# EasyEDA Pro project 嵌入式.eprj, board 运控-电机
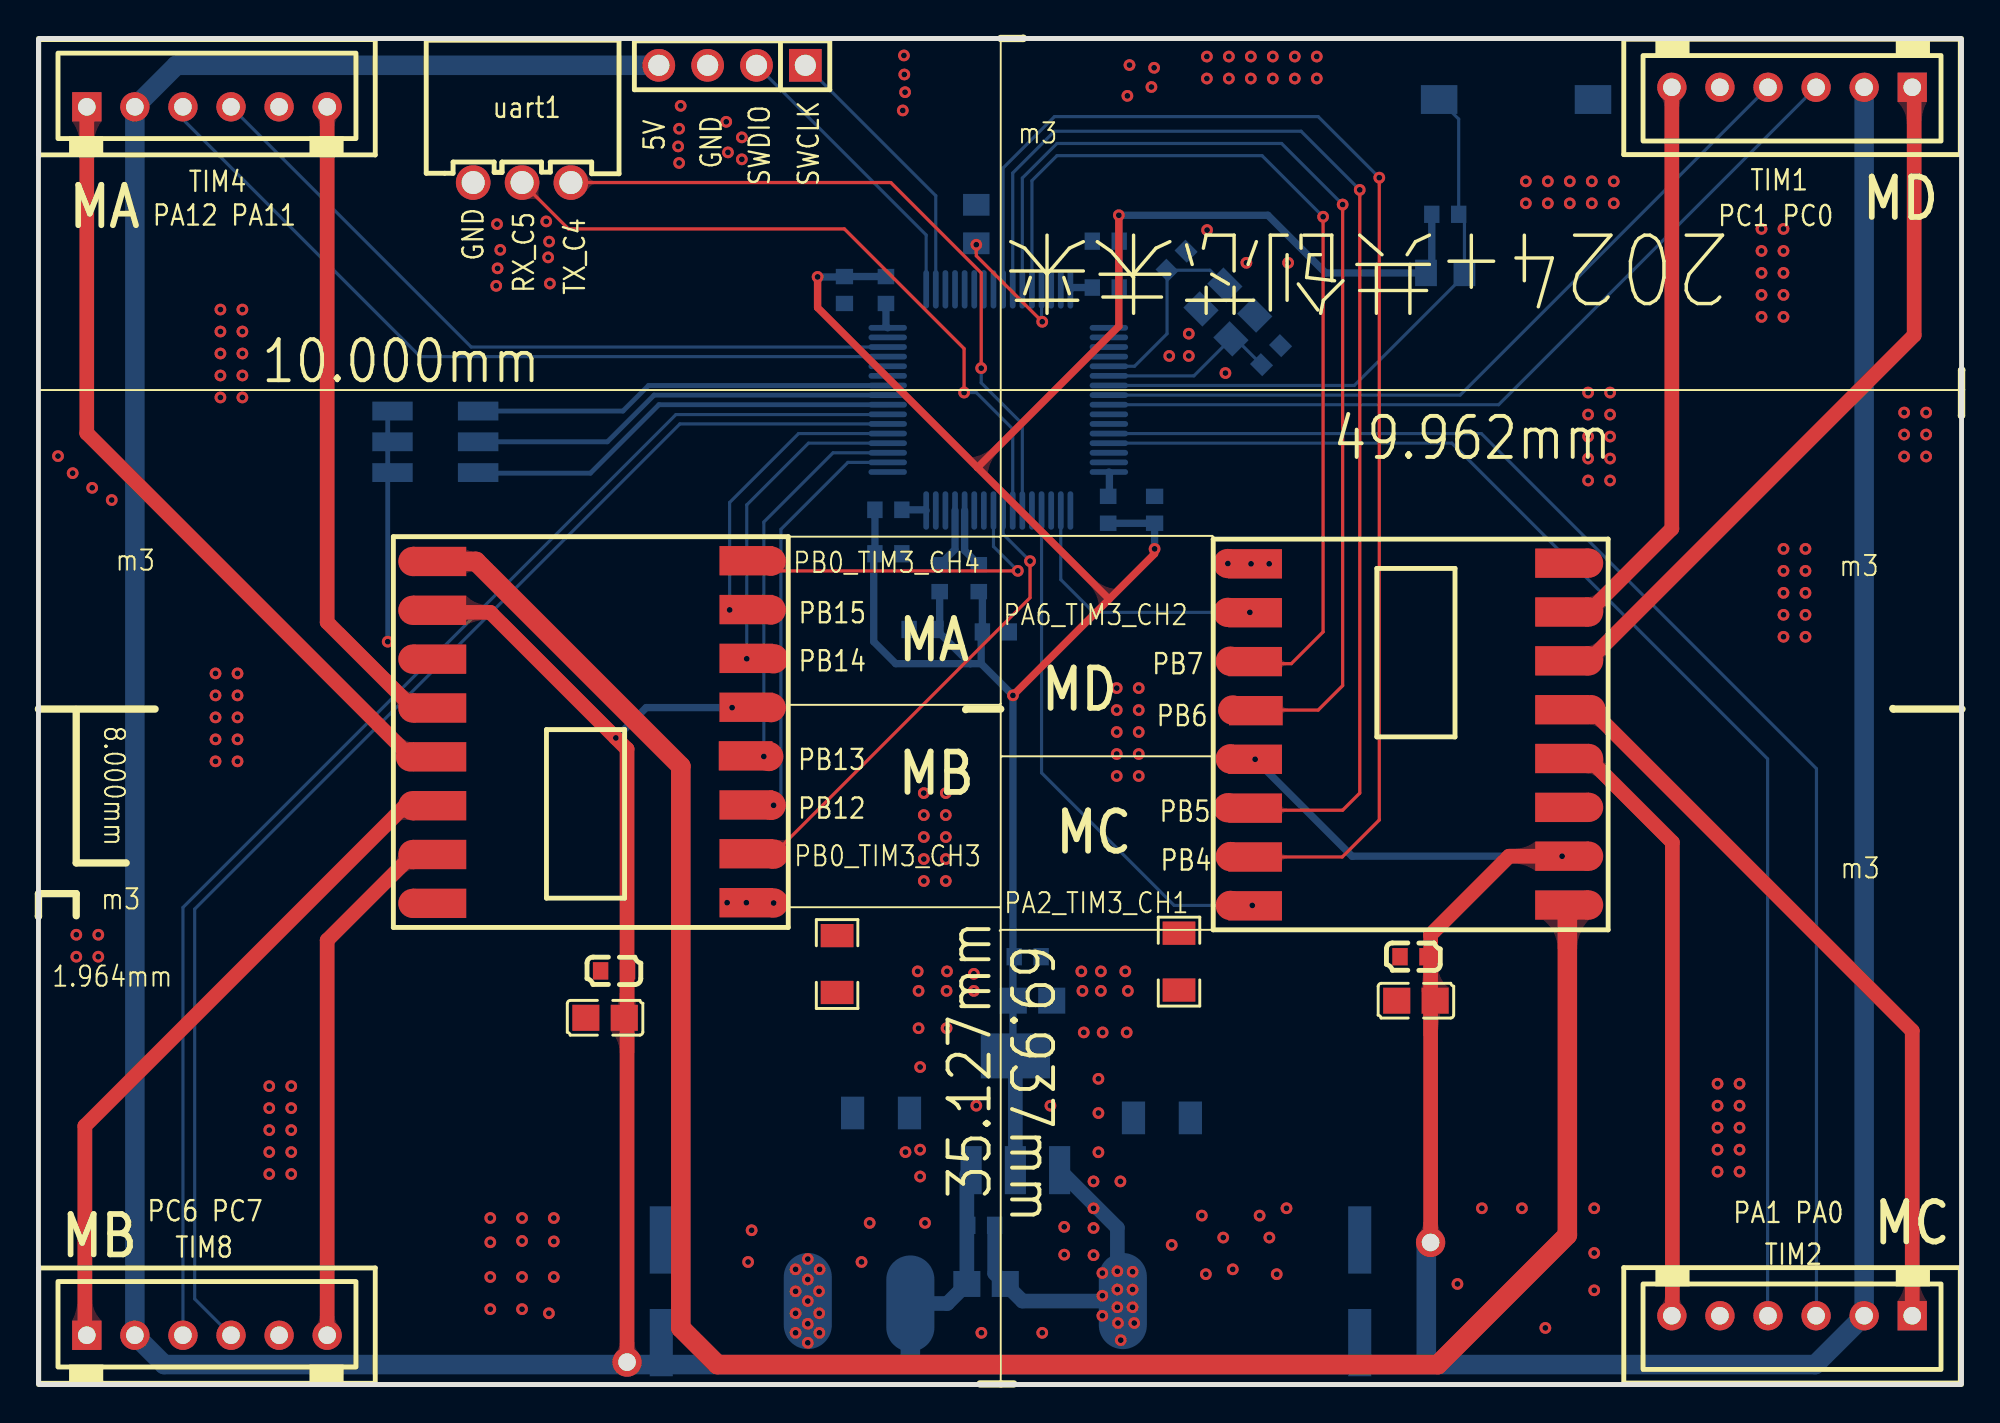
[diagram p6: board, top side]
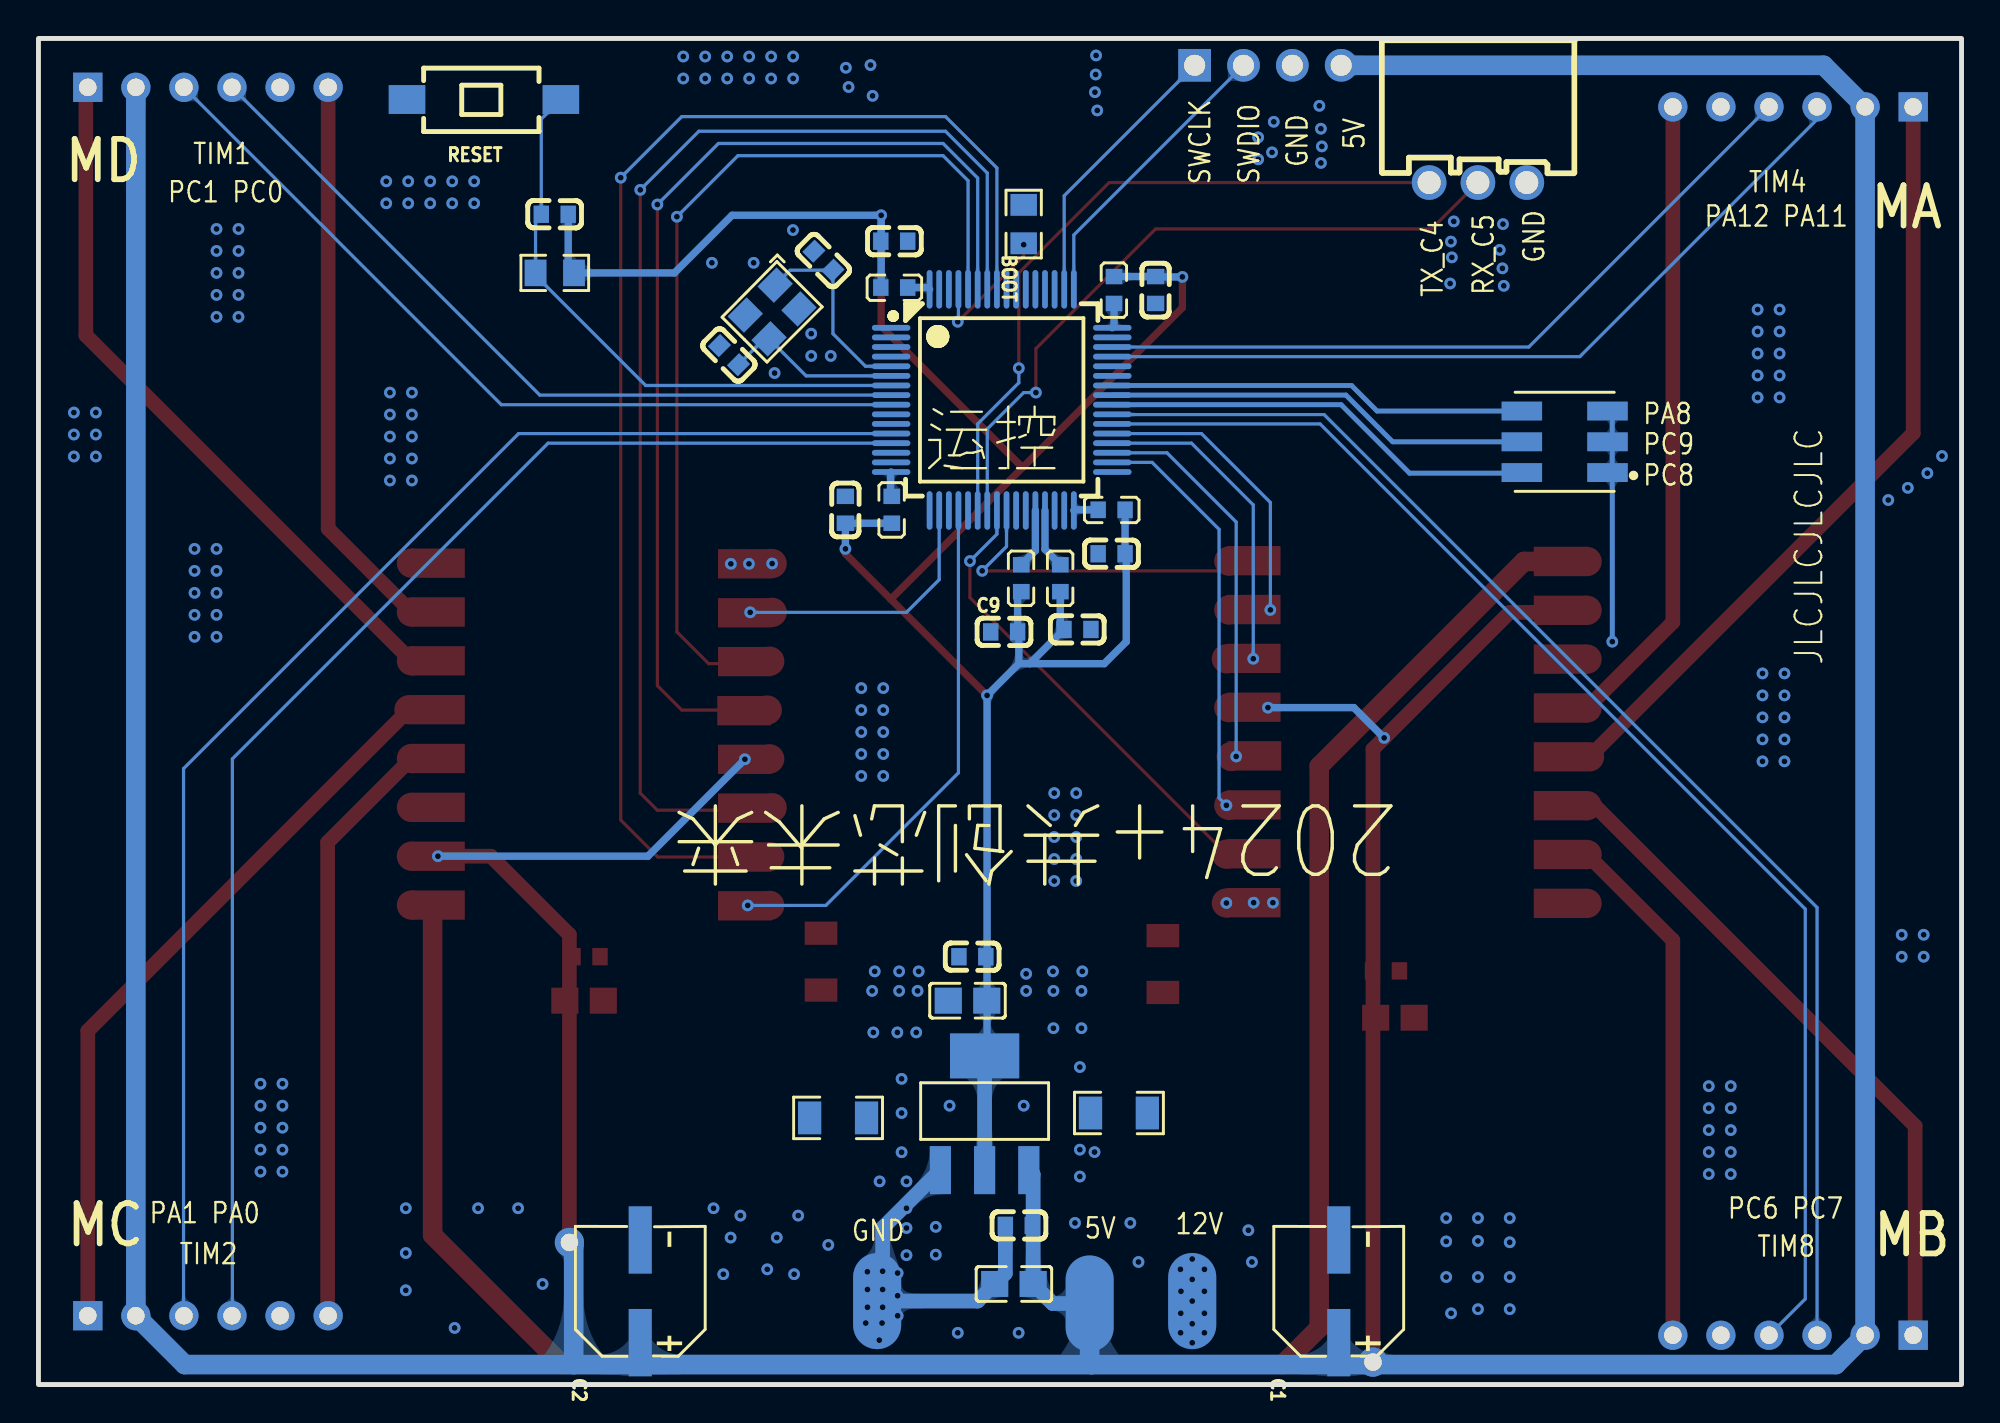
[diagram p7: board, bottom side, seen from below]

Outline 100 x 70 mm; copper layers: Top Layer, Bottom Layer. Coordinates in mm from the lower left corner of the outline.
Outline path: rectangle 0,70 100,0
Stack: Top Layer 0.035mm / Dielectric1 1.51mm FR4 er 4.5 / Bottom Layer 0.035mm

## Design rules (mm)
template: 自定义配置
spacing copperThickness1oz (default): track to track 0.102, other pairs 0.152 to 0.3
spacing copperThickness2oz: track to track 0.203, other pairs 0.152 to 0.3
track width copperThickness1oz (default): min 0.127, default 0.254, max 2.54
track width copperThickness2oz: min 0.203, default 0.254, max 2.54
differential pair differentialPair (default): width min 0.127, default 0.254, max 2.54; gap min 0.152, default 0.152
via viaSize (default): diameter min 0.5, default 0.61, max 10; hole min 0.3, default 0.305, max 6.3

## Placement (name value [footprint] x y rotation side)
A?  BX-XH2.54-6PZZ  [CONN-TH_6P-P2.50_BX-XH2.54-6PZZ]  8.76 66.44 0 top
B?  BX-XH2.54-6PZZ  [CONN-TH_6P-P2.50_BX-XH2.54-6PZZ]  8.76 2.56 0 top
BOOT  10kΩ  [R0805]  48.77 60.35 90 bottom
C  BX-XH2.54-6PZZ  [CONN-TH_6P-P2.50_BX-XH2.54-6PZZ]  91.19 67.46 180 top
C1  220uF  [CAP-SMD_BD6.3-L6.6-W6.6-FD]  32.38 4.85 90 bottom
C2  220uF  [CAP-SMD_BD6.3-L6.6-W6.6-FD]  68.71 4.85 90 bottom
C5  10pF  [C0603]  64.09 53.53 225 bottom
C6  10pF  [C0603]  59.18 58.44 225 bottom
C7  100nF  [C0603]  45.97 39.27 180 bottom
C7#2  -  [C0603]  58.04 45.49 90 bottom
C9  100nF  [C0603]  49.78 39.14 180 bottom
C10  100nF  [C0603]  55.5 59.46 0 bottom
C11  100nF  [C0603]  41.91 56.92 90 bottom
C12  100nF  [C0603]  44.2 43.2 180 bottom
C13  100nF  [C0603]  49.02 8.28 0 bottom
C14  1uF  [C0805]  49.28 5.23 180 bottom
C15  100nF  [C0603]  29.93 21.51 0 top
C15#2  -  [C0603]  71.5 22.25 0 top
C15#3  -  [C0603]  51.44 22.25 180 bottom
C16  1uF  [C0805]  29.46 19.07 180 top
C16#2  -  [C0805]  71.63 19.96 180 top
C16#3  -  [C0805]  51.69 19.96 0 bottom
C17  100nF  [C0603]  73.15 60.86 180 bottom
CN1  XH-3AW  [CONN-TH_3P-P2.54_HCTL_XH-3AW]  25.15 62.51 0 top
D?  BX-XH2.54-6PZZ  [CONN-TH_6P-P2.50_BX-XH2.54-6PZZ]  91.19 3.58 180 top
H1  PZ254V-11-04P  [HDR-TH_4P-P2.54-V-M]  36.07 68.6 180 top
L1  2.2nH  [L0603]  44.2 45.49 0 bottom
L2  2.2nH  [L0603]  46.86 41.93 90 bottom
L3  2.2nH  [L0603]  55.63 45.49 90 bottom
L4  2.2nH  [L0603]  55.5 57.05 0 bottom
L5  2.2nH  [L0603]  44.07 56.92 90 bottom
L6  2.2nH  [L0603]  48.89 41.93 90 bottom
LED1  XL-5050RGBC  [LED-ARRAY-SMD_6P-L5.0-W5.0-TL-RD_3]  20.64 49.03 0 bottom
NOREF  -  [Pad_e84]  79.23 24.93 180 top
NOREF#2  -  [Pad_e38]  38.1 40.28 0 top
NOREF#3  -  [Pad_e14]  20.85 37.72 0 top
NOREF#4  -  [Pad_e51]  36.77 32.69 180 top
NOREF#5  -  [Pad_e86]  79.23 37.63 180 top
NOREF#6  -  [Pad_e139]  63.27 29.98 0 top
NOREF#7  -  [Pad_e83]  79.23 35.09 180 top
NOREF#8  -  [Pad_e13]  19.47 27.56 0 top
NOREF#9  -  [Pad_e72]  38.1 42.82 0 top
NOREF#10  -  [Pad_e16]  20.85 42.8 0 top
NOREF#11  -  [Pad_e8]  19.47 40.26 0 top
NOREF#12  -  [Pad_e9]  19.47 37.72 0 top
NOREF#13  -  [Pad_e110]  61.85 42.7 180 top
NOREF#14  -  [Pad_e53]  36.81 30.14 180 top
NOREF#15  -  [Pad_e11]  19.47 25.02 0 top
NOREF#16  -  [Pad_e54]  36.81 27.6 180 top
NOREF#17  -  [Pad_e55]  37.97 32.66 0 top
NOREF#18  -  [Pad_e6]  19.34 32.64 0 top
NOREF#19  -  [Pad_e122]  63.27 40.14 0 top
NOREF#20  -  [Pad_e77]  80.6 30.01 180 top
NOREF#21  -  [Pad_e120]  63.27 42.68 0 top
NOREF#22  -  [Pad_e140]  61.98 24.92 180 top
NOREF#23  -  [Pad_e123]  62.1 35.08 180 top
NOREF#24  -  [Pad_e109]  61.85 40.16 180 top
NOREF#25  -  [Pad_e12]  19.47 30.1 0 top
NOREF#26  -  [Pad_e88]  79.23 32.55 180 top
NOREF#27  -  [Pad_e457]  30.61 1.17 180 top
NOREF#28  -  [Pad_e18]  20.85 30.1 0 top
NOREF#29  -  [Pad_e119]  63.3 35.04 0 top
NOREF#30  -  [Pad_e520]  40 4.34 180 top
NOREF#31  -  [Pad_e78]  80.6 32.55 180 top
NOREF#32  -  [Pad_e20]  20.85 35.18 0 top
NOREF#33  -  [Pad_e76]  80.6 27.47 180 top
NOREF#34  -  [Pad_e71]  36.81 37.76 180 top
NOREF#35  -  [Pad_e17]  20.85 27.56 0 top
NOREF#36  -  [Pad_e39]  38.1 35.2 0 top
NOREF#37  -  [Pad_e81]  80.6 40.17 180 top
NOREF#38  -  [Pad_e106]  61.98 27.46 180 top
NOREF#39  -  [Pad_e82]  79.23 30.01 180 top
NOREF#40  -  [Pad_e138]  63.27 27.44 0 top
NOREF#41  -  [Pad_e74]  80.73 35.09 180 top
NOREF#42  -  [Pad_e75]  80.6 24.93 180 top
NOREF#43  -  [Pad_e41]  38.23 27.58 0 top
NOREF#44  -  [Pad_e70]  36.81 40.3 180 top
NOREF#45  -  [Pad_e136]  63.27 32.52 0 top
NOREF#46  -  [Pad_e52]  36.81 25.06 180 top
NOREF#47  -  [Pad_e56]  38.1 30.12 0 top
NOREF#48  -  [Pad_e79]  80.6 42.71 180 top
NOREF#49  -  [Pad_e107]  61.98 32.54 180 top
NOREF#50  -  [Pad_e194]  45.34 4.21 180 top
NOREF#51  -  [Pad_e480]  72.39 7.39 180 top
NOREF#52  -  [Pad_e87]  79.23 42.71 180 top
NOREF#53  -  [Pad_e10]  19.47 35.18 0 top
NOREF#54  -  [Pad_e89]  79.23 27.47 180 top
NOREF#55  -  [Pad_e19]  20.85 25.02 0 top
NOREF#56  -  [Pad_e68]  36.81 35.22 180 top
NOREF#57  -  [Pad_e7]  19.47 42.8 0 top
NOREF#58  -  [Pad_e121]  63.27 37.6 0 top
NOREF#59  -  [Pad_e21]  20.85 40.26 0 top
NOREF#60  -  [Pad_e40]  38.23 37.74 0 top
NOREF#61  -  [Pad_e108]  61.85 30 180 top
NOREF#62  -  [Pad_e42]  38.23 25.04 0 top
NOREF#63  -  [Pad_e196]  56.39 4.34 180 top
NOREF#64  -  [Pad_e137]  63.27 24.9 0 top
NOREF#65  -  [Pad_e124]  61.98 37.62 180 top
NOREF#66  -  [Pad_e85]  79.23 40.17 180 top
NOREF#67  -  [Pad_e15]  20.85 32.64 0 top
NOREF#68  -  [Pad_e69]  36.81 42.84 180 top
NOREF#69  -  [Pad_e80]  80.6 37.63 180 top
R2  0Ω  [R1206]  59.31 21.99 270 top
R2#2  -  [R1206]  41.53 21.87 270 top
R2#3  -  [R1206]  58.42 13.87 180 bottom
R2#4  -  [R1206]  43.81 14.12 0 bottom
R3  10kΩ  [R0805]  73.15 57.81 180 bottom
RESET  TS-1101-C-W  [SW-SMD_L6.0-W3.3-LS8.0]  76.84 66.83 180 bottom
U1  STM32G431RBT6  [LQFP-64_L10.0-W10.0-P0.50-LS12.0-BL]  49.91 51.2 270 bottom
U2  AMS1117-3.3  [SOT-223-3_L6.5-W3.5-P3.05-LS7.0]  50.8 14.12 270 bottom
X3  8MHz  [OSC-SMD_4P-L3.2-W2.5-BL]  61.85 55.78 315 bottom

## Footprints (pads in the part's own frame, mm; a bottom-side part is the same pattern mirrored in y, then rotated)
C0603
  rect 0.8x0.9 smd: 1(-0.7,0) 2(0.7,0)
C0805
  rect 1.41x1.35 smd: 1(-1,0) 2(1,0)
CAP-SMD_BD6.3-L6.6-W6.6-FD
  rect 3.5x1.2 smd: 1(-2.67,0) 2(2.67,0)
CONN-TH_3P-P2.54_HCTL_XH-3AW
  round 1.8 hole 1.199: 1(-2.54,0) 2(0.002,0) 3(2.54,0)
CONN-TH_6P-P2.50_BX-XH2.54-6PZZ
  rect 1.524x1.524 hole 0.914: 1(-6.25,0)
  round 1.524 hole 0.914: 2(-3.75,0) 3(-1.25,0) 4(1.25,0) 5(3.75,0) 6(6.25,0)
HDR-TH_4P-P2.54-V-M
  rect 1.7x1.7 hole 1.1: 1(-3.81,0)
  round 1.7 hole 1.1: 2(-1.27,0) 3(1.27,0) 4(3.81,0)
L0603
  rect 0.8x0.864 smd: 1(-0.7,0) 2(0.7,0)
LED-ARRAY-SMD_6P-L5.0-W5.0-TL-RD_3
  rect 2.105x0.98 smd: 1(-2.228,1.6) 2(-2.228,0) 3(-2.228,-1.6) 4(2.228,-1.6) 5(2.228,0) 6(2.228,1.6)
LQFP-64_L10.0-W10.0-P0.50-LS12.0-BL
  oval 0.3x2 smd: 1(-3.75,-5.75) 2(-3.25,-5.75) 3(-2.75,-5.75) 4(-2.25,-5.75) 5(-1.75,-5.75) 6(-1.25,-5.75) 7(-0.75,-5.75) 8(-0.25,-5.75) 9(0.25,-5.75) 10(0.75,-5.75) 11(1.25,-5.75) 12(1.75,-5.75) 13(2.25,-5.75) 14(2.75,-5.75) 15(3.25,-5.75) 16(3.75,-5.75) 33(3.75,5.75) 34(3.25,5.75) 35(2.75,5.75) 36(2.25,5.75) 37(1.75,5.75) 38(1.25,5.75) 39(0.75,5.75) 40(0.25,5.75) 41(-0.25,5.75) 42(-0.75,5.75) 43(-1.25,5.75) 44(-1.75,5.75) 45(-2.25,5.75) 46(-2.75,5.75) 47(-3.25,5.75) 48(-3.75,5.75)
  oval 2x0.3 smd: 17(5.75,-3.75) 18(5.75,-3.25) 19(5.75,-2.75) 20(5.75,-2.25) 21(5.75,-1.75) 22(5.75,-1.25) 23(5.75,-0.75) 24(5.75,-0.25) 25(5.75,0.25) 26(5.75,0.75) 27(5.75,1.25) 28(5.75,1.75) 29(5.75,2.25) 30(5.75,2.75) 31(5.75,3.25) 32(5.75,3.75) 49(-5.75,3.75) 50(-5.75,3.25) 51(-5.75,2.75) 52(-5.75,2.25) 53(-5.75,1.75) 54(-5.75,1.25) 55(-5.75,0.75) 56(-5.75,0.25) 57(-5.75,-0.25) 58(-5.75,-0.75) 59(-5.75,-1.25) 60(-5.75,-1.75) 61(-5.75,-2.25) 62(-5.75,-2.75) 63(-5.75,-3.25) 64(-5.75,-3.75)
OSC-SMD_4P-L3.2-W2.5-BL
  rect 1.4x1.2 smd: 1(-1.1,-0.875) 2(1.1,-0.875) 3(1.1,0.875) 4(-1.1,0.875)
Pad_e6
  round 1.524 smd: 1(0,0)
Pad_e7
  round 1.524 smd: 1(0,0)
Pad_e8
  round 1.524 smd: 1(0,0)
Pad_e9
  round 1.524 smd: 1(0,0)
Pad_e10
  round 1.524 smd: 1(0,0)
Pad_e11
  round 1.524 smd: 1(0,0)
Pad_e12
  round 1.524 smd: 1(0,0)
Pad_e13
  round 1.524 smd: 1(0,0)
Pad_e14
  rect 2.794x1.524 smd: 25(0,0)
Pad_e15
  rect 2.794x1.524 smd: 25(0,0)
Pad_e16
  rect 2.794x1.524 smd: 25(0,0)
Pad_e17
  rect 2.794x1.524 smd: 25(0,0)
Pad_e18
  rect 2.794x1.524 smd: 25(0,0)
Pad_e19
  rect 2.794x1.524 smd: 25(0,0)
Pad_e20
  rect 2.794x1.524 smd: 25(0,0)
Pad_e21
  rect 2.794x1.524 smd: 25(0,0)
Pad_e38
  round 1.524 smd: 1(0,0)
Pad_e39
  round 1.524 smd: 1(0,0)
Pad_e40
  round 1.524 smd: 1(0,0)
Pad_e41
  round 1.524 smd: 1(0,0)
Pad_e42
  round 1.524 smd: 1(0,0)
Pad_e51
  rect 2.794x1.524 smd: 25(0,0)
Pad_e52
  rect 2.794x1.524 smd: 25(0,0)
Pad_e53
  rect 2.794x1.524 smd: 25(0,0)
Pad_e54
  rect 2.794x1.524 smd: 25(0,0)
Pad_e55
  round 1.524 smd: 1(0,0)
Pad_e56
  round 1.524 smd: 1(0,0)
Pad_e68
  rect 2.794x1.524 smd: 25(0,0)
Pad_e69
  rect 2.794x1.524 smd: 25(0,0)
Pad_e70
  rect 2.794x1.524 smd: 25(0,0)
Pad_e71
  rect 2.794x1.524 smd: 25(0,0)
Pad_e72
  round 1.524 smd: 1(0,0)
Pad_e74
  round 1.524 smd: 1(0,0)
Pad_e75
  round 1.524 smd: 1(0,0)
Pad_e76
  round 1.524 smd: 1(0,0)
Pad_e77
  round 1.524 smd: 1(0,0)
Pad_e78
  round 1.524 smd: 1(0,0)
Pad_e79
  round 1.524 smd: 1(0,0)
Pad_e80
  round 1.524 smd: 1(0,0)
Pad_e81
  round 1.524 smd: 1(0,0)
Pad_e82
  rect 2.794x1.524 smd: 25(0,0)
Pad_e83
  rect 2.794x1.524 smd: 25(0,0)
Pad_e84
  rect 2.794x1.524 smd: 25(0,0)
Pad_e85
  rect 2.794x1.524 smd: 25(0,0)
Pad_e86
  rect 2.794x1.524 smd: 25(0,0)
Pad_e87
  rect 2.794x1.524 smd: 25(0,0)
Pad_e88
  rect 2.794x1.524 smd: 25(0,0)
Pad_e89
  rect 2.794x1.524 smd: 25(0,0)
Pad_e106
  round 1.524 smd: 1(0,0)
Pad_e107
  round 1.524 smd: 1(0,0)
Pad_e108
  round 1.524 smd: 1(0,0)
Pad_e109
  round 1.524 smd: 1(0,0)
Pad_e110
  round 1.524 smd: 1(0,0)
Pad_e119
  rect 2.794x1.524 smd: 25(0,0)
Pad_e120
  rect 2.794x1.524 smd: 25(0,0)
Pad_e121
  rect 2.794x1.524 smd: 25(0,0)
Pad_e122
  rect 2.794x1.524 smd: 25(0,0)
Pad_e123
  round 1.524 smd: 1(0,0)
Pad_e124
  round 1.524 smd: 1(0,0)
Pad_e136
  rect 2.794x1.524 smd: 25(0,0)
Pad_e137
  rect 2.794x1.524 smd: 25(0,0)
Pad_e138
  rect 2.794x1.524 smd: 25(0,0)
Pad_e139
  rect 2.794x1.524 smd: 25(0,0)
Pad_e140
  round 1.524 smd: 1(0,0)
Pad_e194
  oval 2.5x5 smd far side: 7(0,0)
Pad_e196
  oval 2.5x5 smd far side: 7(0,0)
Pad_e457
  round 1.524 hole 0.914: 65(0,0)
Pad_e480
  round 1.524 hole 0.914: 65(0,0)
Pad_e520
  oval 2.5x5 smd far side: 7(0,0)
R0805
  rect 1.133x1.377 smd: 1(-1,0) 2(1,0)
R1206
  rect 1.208x1.701 smd: 1(-1.479,0) 2(1.479,0)
SOT-223-3_L6.5-W3.5-P3.05-LS7.0
  rect 2.5x1.1 smd: 1(2.97,-2.3) 2(2.97,0) 3(2.97,2.3)
  rect 2.34x3.6 smd: 4(-2.97,0)
SW-SMD_L6.0-W3.3-LS8.0
  rect 1.9x1.5 smd: 1(-4,0) 2(4,0)

## Nets
5V: A?.2 B?.2 C.2 C1.1 C2.1 C13.1 C14.2 C15.2 C15#2.2 C16.1 C16#2.1 D?.2 H1.4 NOREF#11.1 NOREF#27.65 NOREF#33.1 NOREF#36.1 NOREF#45.25 NOREF#49.1 NOREF#50.7 NOREF#51.65 NOREF#54.25 NOREF#56.25 NOREF#59.25 U2.3
12V: NOREF.25 NOREF#10.25 NOREF#30.7 NOREF#42.1 NOREF#57.1
GND: C1.2 C2.2 C13.2 C14.1 C15.1 C15#2.1 C15#3.1 C16.2 C16#2.2 C16#3.2 LED1.1 LED1.2 LED1.3 NOREF#3.25 NOREF#12.1 NOREF#15.1 NOREF#20.1 NOREF#39.25 NOREF#48.1 NOREF#52.25 NOREF#55.25 NOREF#63.7 R2.2 R2#2.2 R2#3.2 R2#4.2 U2.1
V3.3: C7.1 C7#2.1 C9.2 C10.2 C11.2 C12.2 C15#3.2 C16#3.1 C17.2 L1.1 L2.1 L3.1 L4.2 L5.2 L6.1 R3.2 U2.2 U2.4
VSS: A?.5 B?.5 BOOT.2 C.5 C5.1 C6.1 C7.2 C7#2.2 C9.1 C10.1 C11.1 C12.1 CN1.1 D?.5 H1.3 NOREF#13.1 NOREF#21.25 NOREF#46.25 NOREF#62.1 R2.1 R2#2.1 R2#3.1 R2#4.1 RESET.1 U1.15 U1.31 U1.47 U1.63 X3.2 X3.4
BOOT: BOOT.1 U1.61
INA1: C.4 U1.8
INA2: C.3 U1.9
INB1: D?.3 U1.12
INB2: D?.4 U1.13
INC1: B?.3 U1.39
INC2: B?.4 U1.38
IND1: A?.3 U1.45
IND2: A?.4 U1.46
MA1: A?.6 NOREF#32.25 NOREF#53.1
MA2: A?.1 NOREF#18.1 NOREF#67.25
MB1: B?.1 NOREF#25.1 NOREF#28.25
MB2: B?.6 NOREF#8.1 NOREF#35.25
MC1: C.6 NOREF#37.1 NOREF#66.25
MC2: C.1 NOREF#5.25 NOREF#69.1
MD1: D?.1 NOREF#7.25 NOREF#41.1
MD2: D?.6 NOREF#26.25 NOREF#31.1
PA2: U1.14
PA3: U1.17
PB4: NOREF#38.1 NOREF#40.25 U1.57
PB5: NOREF#6.25 NOREF#61.1 U1.58
PB6: NOREF#23.1 NOREF#29.25 U1.59
PB7: NOREF#58.25 NOREF#65.1 U1.60
PB12: NOREF#14.25 NOREF#47.1 U1.34
PB13: NOREF#4.25 NOREF#17.1 U1.35
PB14: NOREF#34.25 NOREF#60.1 U1.36
PB15: NOREF#2.1 NOREF#44.25 U1.37
PC8: LED1.6 U1.40
PC9: LED1.5 U1.41
PC10: LED1.4 U1.42
PF0: C6.2 U1.5 X3.1
PF1: C5.2 U1.6 X3.3
PWM1: NOREF#19.25 NOREF#24.1 U1.18
PWM2: NOREF#22.1 NOREF#64.25 U1.20
PWM3: NOREF#16.25 NOREF#43.1 U1.24
PWM4: NOREF#9.1 NOREF#68.25 U1.25
RX: CN1.2 U1.23
SWCLK: H1.1 U1.50
SWDIO: H1.2 U1.49
TX: CN1.3 U1.22
$1N1575: L2.2 U1.29
$1N1640: L1.2 U1.32
$1N1686: L3.2 U1.16
$1N1732: L4.1 U1.64
$1N1778: L5.1 U1.48
$1N1857: L6.2 U1.28
$1N2321: C17.1 R3.1 RESET.2 U1.7

Pads without a net: U1 1 2 3 4 10 11 19 21 26 27 30 33 43 44 51 52 53 54 55 56 62

## Via types
v1: diameter 0.61, hole 0.305, Top Layer to Bottom Layer, 281 vias

## Routing (per net, layer and track width the routed paths; a pad name or vN(x,y) marks a point on that pad's centre or on a via; arc(x,y) is an arc through that point)
5V: length 360.4
  Top Layer w0.762: NOREF#27.65 30.61,33.04 v1(30.02,33.63) 23.49,40.16 20.95,40.16 NOREF#59.25 ; NOREF#51.65 72.39,23.39 76.47,27.47 v1(79.23,27.47)
  Bottom Layer w0.381: v1(36.07,35.2) 31.6,35.2 v1(30.02,33.63) ; v1(79.23,27.47) 68.31,27.47 v1(63.27,32.52)
  Bottom Layer w0.762: NOREF#50.7 47.26,4.21 C14.2 48.28,10.93 U2.3
  Bottom Layer w1.016: 45.24,1.04 6.54,1.04 B?.2 A?.2 7.17,68.6 H1.4 ; 45.24,1.04 72.17,1.04 ; 45.24,1.04 45.34,1.14 NOREF#50.7 ; NOREF#51.65 72.17,7.17 72.17,1.04 ; C.2 D?.2 92.4,1.04 72.17,1.04
12V: length 113.1
  Top Layer w1.016: NOREF#10.25 22.75,42.8 33.4,32.15 33.4,2.94 35.31,1.04 72.77,1.04 79.5,7.77 79.5,24.66 NOREF.25
  vias: v1(39.37,5.99) v1(39.37,4.85) v1(39.37,3.71) v1(39.37,2.69) v1(40,6.53) v1(40,5.47) v1(40,4.34) v1(40,3.16) v1(40,2.17) v1(40.59,4.85) v1(40.62,5.99) v1(40.6,3.71) v1(40.61,2.69)
GND: length 29.9
  Bottom Layer w0.254: v1(18.16,38.63) 18.16,50.38 LED1.3
  Bottom Layer w0.762: 56.1,4.34 51.16,4.34 C14.1 49.72,5.78 C13.2 ; 56.1,4.34 NOREF#63.7 ; 56.1,4.34 v1(56.1,4.94) v1(56.1,5.89) 56.1,8.15 U2.1
  vias: v1(23.49,8.66) v1(23.49,7.4) v1(23.49,5.59) v1(23.49,3.92) v1(25.15,8.66) v1(25.15,7.47) v1(25.15,5.59) v1(25.15,3.92) v1(26.54,3.71) v1(26.8,8.66) v1(26.8,7.44) v1(26.8,5.59) v1(36.9,6.37) v1(37.08,8.02) v1(42.8,6.37) v1(43.22,8.41) v1(45.09,12.09) v1(45.72,21.49) v1(45.76,20.47) v1(45.76,18.53) v1(45.85,16.51) v1(45.85,12.22) v1(45.85,10.82) v1(46.1,8.41) v1(47.24,21.49) v1(47.22,20.47) v1(47.22,18.53) v1(48.64,21.36) v1(48.64,20.47) v1(48.77,14.5) v1(49.03,2.69) v1(52.2,2.69) v1(52.62,14.5) v1(53.34,8.2) v1(53.34,6.75) v1(54.23,21.49) v1(54.29,20.47) v1(54.36,18.31) v1(54.86,10.56) v1(54.86,9.17) v1(54.86,8.14) v1(54.86,6.73) v1(55.12,15.9) v1(55.12,14.12) v1(55.12,12.08) v1(55.25,21.49) v1(55.25,20.47) v1(55.34,18.31) v1(55.32,5.8) v1(55.32,4.62) v1(55.32,3.58) v1(56.1,4.02) v1(56.13,3.2) v1(56.26,10.56) v1(56.28,2.31) v1(56.51,21.49) v1(56.59,18.31) v1(56.65,20.47) v1(56.89,4.94) v1(56.89,4.02) v1(56.9,5.87) v1(56.98,3.2) v1(58.93,7.26) v1(60.49,8.79) v1(60.71,5.74) v1(61.61,7.64) v1(62.1,5.99) v1(63.5,8.79) v1(64.01,7.64) v1(64.39,5.74) v1(64.9,9.17) v1(73.79,5.23) v1(75.06,9.17) v1(77.14,9.17) v1(78.36,2.94) v1(80.9,9.17) v1(80.9,6.84) v1(80.9,4.9)
V3.3: length 129.4
  Top Layer w0.381: v1(40.51,57.6) 40.51,56 48.83,47.69 ; v1(56.18,60.81) 56.18,55.04 48.83,47.69 ; 55.68,40.84 48.83,47.69 ; 55.68,40.84 58.04,43.2 v1(58.04,43.46) ; 55.68,40.84 v1(50.67,35.84)
  Bottom Layer w0.381: 49.02,37.49 48.45,37.49 ; 49.02,37.49 v1(50.67,35.84) 50.67,17.42 ; 49.02,37.49 49.02,39.08 C9.2 49.08,41.04 L6.1 ; 48.45,37.49 C7.1 46.86,39.46 L2.1 ; 48.45,37.49 44.58,37.49 43.43,38.63 43.43,43.14 C12.2 L1.1 ; C17.2 72.45,58.11 R3.2 66.93,57.81 63.93,60.81 v1(56.18,60.81) 56.18,57.07 L4.2 ; L5.2 C11.2 41.89,57.6 v1(40.51,57.6) ; L3.1 C7#2.1 v1(58.04,43.46)
  Bottom Layer w0.762: U2.2 U2.4
VSS:
  vias: v1(1.02,48.28) v1(1.78,47.39) v1(1.97,23.39) v1(1.97,22.25) v1(2.79,46.63) v1(3.11,23.39) v1(3.11,22.25) v1(3.81,46) v1(9.21,36.98) v1(9.21,35.84) v1(9.21,34.69) v1(9.21,33.55) v1(9.21,32.41) v1(9.46,55.9) v1(9.46,54.76) v1(9.46,53.62) v1(9.46,52.47) v1(9.46,51.33) v1(10.35,36.98) v1(10.35,35.84) v1(10.35,34.69) v1(10.35,33.55) v1(10.35,32.41) v1(10.6,55.9) v1(10.6,54.76) v1(10.6,53.62) v1(10.6,52.47) v1(10.6,51.33) v1(12,15.52) v1(12,14.37) v1(12,13.23) v1(12,12.09) v1(12,10.95) v1(13.14,15.52) v1(13.14,14.37) v1(13.14,13.23) v1(13.14,12.09) v1(13.14,10.95) v1(23.84,60.35) v1(23.87,58.05) v1(23.8,57.14) v1(24.01,59.01) v1(26.4,60.49) v1(26.55,59.44) v1(26.5,58.62) v1(26.59,57.26) v1(33.26,64.39) v1(33.31,65.31) v1(33.31,63.53) v1(33.39,66.5) v1(35.76,65.67) v1(35.85,64.08) v1(35.81,25.06) v1(36.58,64.86) v1(36.58,63.71) v1(36.81,25.06) v1(38.23,25.04) v1(44.94,66.26) v1(45,69.12) v1(45.02,68.13) v1(45.06,67.21) v1(46.04,30.76) v1(46.04,29.61) v1(46.04,28.47) v1(46.04,27.33) v1(46.04,26.19) v1(47.18,30.76) v1(47.18,29.61) v1(47.18,28.47) v1(47.18,27.33) v1(47.18,26.19) v1(56.07,36.22) v1(56.07,35.08) v1(56.07,33.93) v1(56.07,32.79) v1(56.07,31.65) v1(56.62,67.02) v1(56.73,68.62) v1(57.21,36.22) v1(57.21,35.08) v1(57.21,33.93) v1(57.21,32.79) v1(57.21,31.65) v1(57.87,67.48) v1(58.01,68.48) v1(58.8,53.49) v1(59.82,54.65) v1(59.82,53.49) v1(60.76,69.06) v1(60.76,67.92) v1(60.77,60.04) v1(61.72,52.6) v1(61.85,42.7) v1(61.9,69.06) v1(61.9,67.92) v1(62.81,58.33) v1(63.04,69.06) v1(63.04,67.92) v1(63.05,42.68) v1(64,42.68) v1(64.19,69.06) v1(64.19,67.92) v1(64.98,58.33) v1(65.33,69.06) v1(65.33,67.92) v1(66.47,69.06) v1(66.47,67.92) v1(77.34,62.57) v1(77.34,61.43) v1(78.49,62.57) v1(78.49,61.43) v1(79.63,62.57) v1(79.63,61.43) v1(80.58,51.59) v1(80.58,50.44) v1(80.58,49.3) v1(80.58,48.16) v1(80.58,47.01) v1(80.77,62.57) v1(80.77,61.43) v1(81.72,51.59) v1(81.72,50.44) v1(81.72,49.3) v1(81.72,48.16) v1(81.72,47.01) v1(81.91,62.57) v1(81.91,61.43) v1(87.31,15.64) v1(87.31,14.5) v1(87.31,13.36) v1(87.31,12.22) v1(87.31,11.07) v1(88.46,15.64) v1(88.46,14.5) v1(88.46,13.36) v1(88.46,12.22) v1(88.46,11.07) v1(89.6,60.09) v1(89.6,58.95) v1(89.6,57.81) v1(89.6,56.67) v1(89.6,55.52) v1(90.74,60.09) v1(90.74,58.95) v1(90.74,57.81) v1(90.74,56.67) v1(90.74,55.52) v1(90.74,43.46) v1(90.74,42.31) v1(90.74,41.17) v1(90.74,40.03) v1(90.74,38.89) v1(91.88,43.46) v1(91.88,42.31) v1(91.88,41.17) v1(91.88,40.03) v1(91.88,38.89) v1(97.02,50.55) v1(97.02,49.4) v1(97.02,48.26) v1(98.16,50.55) v1(98.16,49.4) v1(98.16,48.26)
BOOT: length 7.1
  Top Layer w0.165: v1(48.77,59.28) 48.77,58.7 v1(52.2,55.27)
  Bottom Layer w0.165: v1(52.2,55.27) 52.16,55.3 U1.61
INA1: length 40.9
  Bottom Layer w0.165: U1.8 73.93,51.45 C.4
INA2: length 43.6
  Bottom Layer w0.165: C.3 75.93,50.95 U1.9
INB1: length 72.5
  Bottom Layer w0.165: U1.12 75.03,49.45 92.46,32.03 92.46,3.6 D?.3
INB2: length 70
  Bottom Layer w0.165: U1.13 73.5,48.95 89.92,32.54 89.92,3.6 D?.4
INC1: length 69.5
  Bottom Layer w0.165: B?.3 7.51,24.81 33.15,50.44 44.15,50.44 U1.39
INC2: length 69.4
  Bottom Layer w0.165: U1.38 33.35,49.95 8.12,24.73 8.12,4.45 B?.4
IND1: length 42.4
  Bottom Layer w0.165: A?.3 7.51,65.79 19.85,53.45 U1.45
IND2: length 39.3
  Bottom Layer w0.165: A?.4 22.5,53.95 U1.46
MA1: length 33.1
  Top Layer w0.762: A?.6 15.01,39.64 NOREF#53.1
MA2: length 40.8
  Top Layer w0.762: A?.1 2.51,49.47 NOREF#18.1
MB1: length 36.3
  Top Layer w0.762: NOREF#28.25 19.07,30.1 2.41,13.45 2.41,2.66 B?.1
MB2: length 26.8
  Top Layer w0.762: B?.6 15.01,23.1 NOREF#8.1
MC1: length 29.1
  Top Layer w0.762: C.6 84.94,44.51 NOREF#37.1
MC2: length 36.9
  Top Layer w0.762: NOREF#69.1 97.54,54.57 97.54,67.36 C.1
MD1: length 38.4
  Top Layer w0.762: NOREF#41.1 97.44,18.39 D?.1
MD2: length 30.8
  Top Layer w0.762: D?.6 84.96,3.61 84.96,28.2 NOREF#31.1
PB4: length 69
  Top Layer w0.165: v1(69.72,62.76) 69.72,29.36 67.8,27.44 NOREF#40.25
  Bottom Layer w0.165: v1(69.72,62.76) 66.55,65.94 52.83,65.94 50.16,63.27 U1.57
PB5: length 63.5
  Top Layer w0.165: v1(68.71,62.13) 68.71,30.76 67.82,29.87 63.37,29.87 NOREF#6.25
  Bottom Layer w0.165: U1.58 50.66,63 52.83,65.17 65.66,65.17 v1(68.71,62.13)
PB6: length 54.6
  Top Layer w0.165: NOREF#29.25 63.33,35.08 66.55,35.08 67.82,36.35 v1(67.82,61.36)
  Bottom Layer w0.165: U1.59 51.16,62.74 52.96,64.54 64.64,64.54 v1(67.82,61.36)
PB7: length 48.5
  Top Layer w0.165: v1(66.8,60.73) 66.8,39.14 65.15,37.49 63.37,37.49 NOREF#58.25
  Bottom Layer w0.165: U1.60 51.66,62.61 52.96,63.9 63.63,63.9 v1(66.8,60.73)
PB12: length 21.5
  Bottom Layer w0.165: U1.34 42.09,47.95 38.61,44.47 38.61,30.5 v1(38.23,30.12)
PB13: length 20.1
  Bottom Layer w0.165: v1(37.72,32.66) 37.72,44.85 41.32,48.45 U1.35
PB14: length 16.7
  Bottom Layer w0.165: U1.36 40.04,48.95 36.83,45.74 v1(36.83,37.74)
PB15: length 15.3
  Bottom Layer w0.165: v1(35.94,40.28) 35.94,45.87 39.53,49.45 U1.37
PC8: length 22.8
  Bottom Layer w0.254: U1.40 32.26,50.95 28.7,47.39 22.9,47.39 LED1.6
PC9: length 22.3
  Bottom Layer w0.254: LED1.5 29.58,49.03 32.01,51.45 U1.41
PC10: length 21.8
  Bottom Layer w0.254: LED1.4 30.39,50.63 31.72,51.95 U1.42
PF0: length 10.4
  Bottom Layer w0.165: X3.1 60.91,57.95 C6.2 58.69,54.65 57,52.95 U1.5
PF1: length 9.3
  Bottom Layer w0.165: U1.6 60.08,52.45 X3.3 62.26,54.38 C5.2
PWM1: length 14.1
  Bottom Layer w0.165: U1.18 53.16,41.86 54.86,40.16 v1(62.99,40.16)
PWM2: length 27.5
  Bottom Layer w0.165: v1(63.12,24.92) 59.06,24.92 52.16,31.81 U1.20
PWM3: length 24
  Top Layer w0.165: v1(51.56,42.82) 51.56,40.92 NOREF#43.1
  Bottom Layer w0.165: U1.24 50.16,44.22 v1(51.56,42.82)
PWM4: length 16.7
  Top Layer w0.165: v1(50.93,42.31) 38.61,42.31 NOREF#9.1
  Bottom Layer w0.165: U1.25 49.66,43.58 v1(50.93,42.31)
RX: length 36.5
  Top Layer w0.165: v1(48.13,51.59) 48.13,53.87 41.91,60.09 27.56,60.09 CN1.2
  Bottom Layer w0.165: 50.66,45.33 50.66,49.69 48.77,51.59 v1(48.13,51.59)
SWCLK: length 14.5
  Bottom Layer w0.165: U1.50 46.66,61.82 H1.1
SWDIO: length 15.3
  Bottom Layer w0.165: U1.49 46.16,59.78 H1.2
TX: length 36.6
  Top Layer w0.165: v1(49.02,52.86) 49.02,57.81 44.32,62.51 CN1.3
  Bottom Layer w0.165: 51.16,45.33 51.16,49.95 49.02,52.09 v1(49.02,52.86)
$1N1575: length 3.2
  Bottom Layer w0.381: U1.29 47.66,43.43 L2.2
$1N1640: length 1.3
  Bottom Layer w0.381: L1.2 46.13,45.49 U1.32
$1N1686: length 1.3
  Bottom Layer w0.381: 55.69,46.12 55.69,47.43 U1.16
$1N1732: length 1.2
  Bottom Layer w0.381: L4.1 53.75,57.05 U1.64
$1N1778: length 1.3
  Bottom Layer w0.381: U1.48 44.07,55.05 L5.1
$1N1857: length 3.1
  Bottom Layer w0.381: L6.2 48.16,43.37 U1.28
$1N2321: length 30.6
  Bottom Layer w0.165: U1.7 68.42,51.95 74.28,57.81 ; RESET.2 73.85,65.81 C17.1 74.15,60.56 R3.1

## Copper pours and planes (outline as drawn; the poured copper is in the pictures)
12V on Top Layer: 38.1,7.01 41.66,7.01 41.66,0.53 38.1,0.53
GND on Top Layer: 82.68,44.98 70.87,44.98 70.87,26.06 66.29,21.49 32.19,21.49 26.42,27.26 26.42,36.22 22.99,39.65 18.41,39.65 16.51,37.74 16.51,5.1 19.68,1.93 78.56,1.93 82.71,6.08 82.71,44.95
GND on Bottom Layer: 44.45,23.65 57.78,23.65 57.78,1.8 44.45,1.8
GND on Bottom Layer: 22.22,10.06 81.28,10.06 81.28,2.31 22.22,2.31
VSS on Top Layer: 0,69.79 99.94,69.79 99.94,0.08 0,0.08
VSS on Bottom Layer: 0.01,69.94 99.94,69.94 99.94,0.08 0.01,0.08

Small or netless copper shapes (teardrops, artwork), in the pictures only: 58 on Top Layer, 164 on Bottom Layer

## Text on the board
Bottom Silkscreen Layer: GND | RX_C5 | TX_C4 | 5V | SWDIO | SWCLK | TIM8 | TIM4 | PC6 PC7 | PA12 PA11 | PA8 | PC9 | PC8 | 12V | TIM1 | TIM2 | PC1 PC0 | PA1 PA0 | JLCJLCJLCJLC | MB | MA | MC | MD | 运控 | 2024+共创芯未来
Top Silkscreen Layer: 1.964mm | m3 | PB0_TIM3_CH4 | PB0_TIM3_CH3 | PA6_TIM3_CH2 | PA2_TIM3_CH1 | 8.000mm | PC6 PC7 | PA12 PA11 | TIM8 | TIM4 | PB13 | PB12 | PB15 | PB14 | PB7 | PB6 | PB5 | PB4 | PC1 PC0 | PA1 PA0 | TIM1 | TIM2 | GND | RX_C5 | TX_C4 | 5V | SWDIO | SWCLK | uart1 | MB | MA | MD | MC | 69.937mm | 10.000mm | 49.962mm | 35.127mm | 2024+共创芯未来
